# EAGLE schematic Resistor_Resistor (EAGLE 8.3.0), part 7 of 43 (continued)
## Parts (continued)
R9514  10K  RESISTOR_0201  [0201]
R9515  10K  RESISTOR_0201  [0201]
R9516  10K  RESISTOR_0201  [0201]
R9517  10K  RESISTOR_0201  [0201]
R9518  10K  RESISTOR_0201  [0201]
R9519  10K  RESISTOR_0201  [0201]
R9520  10K  RESISTOR_0201  [0201]
R9521  10K  RESISTOR_0201  [0201]
R9522  10K  RESISTOR_0201  [0201]
R9523  10K  RESISTOR_0201  [0201]
R9524  10K  RESISTOR_0201  [0201]
R9525  10K  RESISTOR_0201  [0201]
R9526  10K  RESISTOR_0201  [0201]
R9527  10K  RESISTOR_0201  [0201]
R9528  10K  RESISTOR_0201  [0201]
R9529  10K  RESISTOR_0201  [0201]
R9530  10K  RESISTOR_0201  [0201]
R9531  10K  RESISTOR_0201  [0201]
R9532  10K  RESISTOR_0201  [0201]
R9533  10K  RESISTOR_0201  [0201]
R9534  10K  RESISTOR_0201  [0201]
R9535  10K  RESISTOR_0201  [0201]
R9536  10K  RESISTOR_0201  [0201]
R9537  10K  RESISTOR_0201  [0201]
R9538  10K  RESISTOR_0201  [0201]
R9539  10K  RESISTOR_0201  [0201]
R9540  10K  RESISTOR_0201  [0201]
R9541  10K  RESISTOR_0201  [0201]
R9542  10K  RESISTOR_0201  [0201]
R9543  10K  RESISTOR_0201  [0201]
R9544  10K  RESISTOR_0201  [0201]
R9545  10K  RESISTOR_0201  [0201]
R9546  10K  RESISTOR_0201  [0201]
R9547  10K  RESISTOR_0201  [0201]
R9548  10K  RESISTOR_0201  [0201]
R9549  10K  RESISTOR_0201  [0201]
R9550  10K  RESISTOR_0201  [0201]
R9551  10K  RESISTOR_0201  [0201]
R9552  10K  RESISTOR_0201  [0201]
R9553  10K  RESISTOR_0201  [0201]
R9554  10K  RESISTOR_0201  [0201]
R9555  10K  RESISTOR_0201  [0201]
R9556  10K  RESISTOR_0201  [0201]
R9557  10K  RESISTOR_0201  [0201]
R9558  10K  RESISTOR_0201  [0201]
R9559  10K  RESISTOR_0201  [0201]
R9560  10K  RESISTOR_0201  [0201]
R9561  10K  RESISTOR_0201  [0201]
R9562  10K  RESISTOR_0201  [0201]
R9563  10K  RESISTOR_0201  [0201]
R9564  10K  RESISTOR_0201  [0201]
R9565  10K  RESISTOR_0201  [0201]
R9566  10K  RESISTOR_0201  [0201]
R9567  10K  RESISTOR_0201  [0201]
R9568  10K  RESISTOR_0201  [0201]
R9569  10K  RESISTOR_0201  [0201]
R9570  10K  RESISTOR_0201  [0201]
R9571  10K  RESISTOR_0201  [0201]
R9572  10K  RESISTOR_0201  [0201]
R9573  10K  RESISTOR_0201  [0201]
R9574  10K  RESISTOR_0201  [0201]
R9575  10K  RESISTOR_0201  [0201]
R9576  10K  RESISTOR_0201  [0201]
R9577  10K  RESISTOR_0201  [0201]
R9578  10K  RESISTOR_0201  [0201]
R9579  10K  RESISTOR_0201  [0201]
R9580  10K  RESISTOR_0201  [0201]
R9581  10K  RESISTOR_0201  [0201]
R9582  10K  RESISTOR_0201  [0201]
R9583  10K  RESISTOR_0201  [0201]
R9584  10K  RESISTOR_0201  [0201]
R9585  10K  RESISTOR_0201  [0201]
R9586  10K  RESISTOR_0201  [0201]
R9587  10K  RESISTOR_0201  [0201]
R9588  10K  RESISTOR_0201  [0201]
R9589  10K  RESISTOR_0201  [0201]
R9590  10K  RESISTOR_0201  [0201]
R9591  10K  RESISTOR_0201  [0201]
R9592  10K  RESISTOR_0201  [0201]
R9593  10K  RESISTOR_0201  [0201]
R9594  10K  RESISTOR_0201  [0201]
R9595  10K  RESISTOR_0201  [0201]
R9596  10K  RESISTOR_0201  [0201]
R9597  10K  RESISTOR_0201  [0201]
R9598  10K  RESISTOR_0201  [0201]
R9599  10K  RESISTOR_0201  [0201]
R9600  10K  RESISTOR_0201  [0201]
R9601  10K  RESISTOR_0201  [0201]
R9602  10K  RESISTOR_0201  [0201]
R9603  10K  RESISTOR_0201  [0201]
R9604  10K  RESISTOR_0201  [0201]
R9605  10K  RESISTOR_0201  [0201]
R9606  10K  RESISTOR_0201  [0201]
R9607  10K  RESISTOR_0201  [0201]
R9608  10K  RESISTOR_0201  [0201]
R9609  10K  RESISTOR_0201  [0201]
R9610  10K  RESISTOR_0201  [0201]
R9611  10K  RESISTOR_0201  [0201]
R9612  10K  RESISTOR_0201  [0201]
R9613  10K  RESISTOR_0201  [0201]
R9614  10K  RESISTOR_0201  [0201]
R9615  10K  RESISTOR_0201  [0201]
R9616  10K  RESISTOR_0201  [0201]
R9617  10K  RESISTOR_0201  [0201]
R9618  10K  RESISTOR_0201  [0201]
R9619  10K  RESISTOR_0201  [0201]
R9620  10K  RESISTOR_0201  [0201]
R9621  10K  RESISTOR_0201  [0201]
R9622  10K  RESISTOR_0201  [0201]
R9623  10K  RESISTOR_0201  [0201]
R9624  10K  RESISTOR_0201  [0201]
R9625  10K  RESISTOR_0201  [0201]
R9626  10K  RESISTOR_0201  [0201]
R9627  10K  RESISTOR_0201  [0201]
R9628  10K  RESISTOR_0201  [0201]
R9629  10K  RESISTOR_0201  [0201]
R9630  10K  RESISTOR_0201  [0201]
R9631  10K  RESISTOR_0201  [0201]
R9632  10K  RESISTOR_0201  [0201]
R9633  10K  RESISTOR_0201  [0201]
R9634  10K  RESISTOR_0201  [0201]
R9635  10K  RESISTOR_0201  [0201]
R9636  10K  RESISTOR_0201  [0201]
R9637  10K  RESISTOR_0201  [0201]
R9638  10K  RESISTOR_0201  [0201]
R9639  10K  RESISTOR_0201  [0201]
R9640  10K  RESISTOR_0201  [0201]
R9641  10K  RESISTOR_0201  [0201]
R9642  10K  RESISTOR_0201  [0201]
R9643  10K  RESISTOR_0201  [0201]
R9644  10K  RESISTOR_0201  [0201]
R9645  10K  RESISTOR_0201  [0201]
R9646  10K  RESISTOR_0201  [0201]
R9647  10K  RESISTOR_0201  [0201]
R9648  10K  RESISTOR_0201  [0201]
R9649  10K  RESISTOR_0201  [0201]
R9650  10K  RESISTOR_0201  [0201]
R9651  10K  RESISTOR_0201  [0201]
R9652  10K  RESISTOR_0201  [0201]
R9653  10K  RESISTOR_0201  [0201]
R9654  10K  RESISTOR_0201  [0201]
R9655  10K  RESISTOR_0201  [0201]
R9656  10K  RESISTOR_0201  [0201]
R9657  10K  RESISTOR_0201  [0201]
R9658  10K  RESISTOR_0201  [0201]
R9659  10K  RESISTOR_0201  [0201]
R9660  10K  RESISTOR_0201  [0201]
R9661  10K  RESISTOR_0201  [0201]
R9662  10K  RESISTOR_0201  [0201]
R9663  10K  RESISTOR_0201  [0201]
R9664  10K  RESISTOR_0201  [0201]
R9665  10K  RESISTOR_0201  [0201]
R9666  10K  RESISTOR_0201  [0201]
R9667  10K  RESISTOR_0201  [0201]
R9668  10K  RESISTOR_0201  [0201]
R9669  10K  RESISTOR_0201  [0201]
R9670  10K  RESISTOR_0201  [0201]
R9671  10K  RESISTOR_0201  [0201]
R9672  10K  RESISTOR_0201  [0201]
R9673  10K  RESISTOR_0201  [0201]
R9674  10K  RESISTOR_0201  [0201]
R9675  10K  RESISTOR_0201  [0201]
R9676  10K  RESISTOR_0201  [0201]
R9677  10K  RESISTOR_0201  [0201]
R9678  10K  RESISTOR_0201  [0201]
R9679  10K  RESISTOR_0201  [0201]
R9680  10K  RESISTOR_0201  [0201]
R9681  10K  RESISTOR_0201  [0201]
R9682  10K  RESISTOR_0201  [0201]
R9683  10K  RESISTOR_0201  [0201]
R9684  10K  RESISTOR_0201  [0201]
R9685  10K  RESISTOR_0201  [0201]
R9686  10K  RESISTOR_0201  [0201]
R9687  10K  RESISTOR_0201  [0201]
R9688  10K  RESISTOR_0201  [0201]
R9689  10K  RESISTOR_0201  [0201]
R9690  10K  RESISTOR_0201  [0201]
R9691  10K  RESISTOR_0201  [0201]
R9692  10K  RESISTOR_0201  [0201]
R9693  10K  RESISTOR_0201  [0201]
R9694  10K  RESISTOR_0201  [0201]
R9695  10K  RESISTOR_0201  [0201]
R9696  10K  RESISTOR_0201  [0201]
R9697  10K  RESISTOR_0201  [0201]
R9698  10K  RESISTOR_0201  [0201]
R9699  10K  RESISTOR_0201  [0201]
R9700  10K  RESISTOR_0201  [0201]
R9701  10K  RESISTOR_0201  [0201]
R9702  10K  RESISTOR_0201  [0201]
R9703  10K  RESISTOR_0201  [0201]
R9704  10K  RESISTOR_0201  [0201]
R9705  10K  RESISTOR_0201  [0201]
R9706  10K  RESISTOR_0201  [0201]
R9707  10K  RESISTOR_0201  [0201]
R9708  10K  RESISTOR_0201  [0201]
R9709  10K  RESISTOR_0201  [0201]
R9710  10K  RESISTOR_0201  [0201]
R9711  10K  RESISTOR_0201  [0201]
R9712  10K  RESISTOR_0201  [0201]
R9713  10K  RESISTOR_0201  [0201]
R9714  10K  RESISTOR_0201  [0201]
R9715  10K  RESISTOR_0201  [0201]
R9716  10K  RESISTOR_0201  [0201]
R9717  10K  RESISTOR_0201  [0201]
R9718  10K  RESISTOR_0201  [0201]
R9719  10K  RESISTOR_0201  [0201]
R9720  10K  RESISTOR_0201  [0201]
R9721  10K  RESISTOR_0201  [0201]
R9722  10K  RESISTOR_0201  [0201]
R9723  10K  RESISTOR_0201  [0201]
R9724  10K  RESISTOR_0201  [0201]
R9725  10K  RESISTOR_0201  [0201]
R9726  10K  RESISTOR_0201  [0201]
R9727  10K  RESISTOR_0201  [0201]
R9728  10K  RESISTOR_0201  [0201]
R9729  10K  RESISTOR_0201  [0201]
R9730  10K  RESISTOR_0201  [0201]
R9731  10K  RESISTOR_0201  [0201]
R9732  10K  RESISTOR_0201  [0201]
R9733  10K  RESISTOR_0201  [0201]
R9734  10K  RESISTOR_0201  [0201]
R9735  10K  RESISTOR_0201  [0201]
R9736  10K  RESISTOR_0201  [0201]
R9737  10K  RESISTOR_0201  [0201]
R9738  10K  RESISTOR_0201  [0201]
R9739  10K  RESISTOR_0201  [0201]
R9740  10K  RESISTOR_0201  [0201]
R9741  10K  RESISTOR_0201  [0201]
R9742  10K  RESISTOR_0201  [0201]
R9743  10K  RESISTOR_0201  [0201]
R9744  10K  RESISTOR_0201  [0201]
R9745  10K  RESISTOR_0201  [0201]
R9746  10K  RESISTOR_0201  [0201]
R9747  10K  RESISTOR_0201  [0201]
R9748  10K  RESISTOR_0201  [0201]
R9749  10K  RESISTOR_0201  [0201]
R9750  10K  RESISTOR_0201  [0201]
R9751  10K  RESISTOR_0201  [0201]
R9752  10K  RESISTOR_0201  [0201]
R9753  10K  RESISTOR_0201  [0201]
R9754  10K  RESISTOR_0201  [0201]
R9755  10K  RESISTOR_0201  [0201]
R9756  10K  RESISTOR_0201  [0201]
R9757  10K  RESISTOR_0201  [0201]
R9758  10K  RESISTOR_0201  [0201]
R9759  10K  RESISTOR_0201  [0201]
R9760  10K  RESISTOR_0201  [0201]
R9761  10K  RESISTOR_0201  [0201]
R9762  10K  RESISTOR_0201  [0201]
R9763  10K  RESISTOR_0201  [0201]
R9764  10K  RESISTOR_0201  [0201]
R9765  10K  RESISTOR_0201  [0201]
R9766  10K  RESISTOR_0201  [0201]
R9767  10K  RESISTOR_0201  [0201]
R9768  10K  RESISTOR_0201  [0201]
R9769  10K  RESISTOR_0201  [0201]
R9770  10K  RESISTOR_0201  [0201]
R9771  10K  RESISTOR_0201  [0201]
R9772  10K  RESISTOR_0201  [0201]
R9773  10K  RESISTOR_0201  [0201]
R9774  10K  RESISTOR_0201  [0201]
R9775  10K  RESISTOR_0201  [0201]
R9776  10K  RESISTOR_0201  [0201]
R9777  10K  RESISTOR_0201  [0201]
R9778  10K  RESISTOR_0201  [0201]
R9779  10K  RESISTOR_0201  [0201]
R9780  10K  RESISTOR_0201  [0201]
R9781  10K  RESISTOR_0201  [0201]
R9782  10K  RESISTOR_0201  [0201]
R9783  10K  RESISTOR_0201  [0201]
R9784  10K  RESISTOR_0201  [0201]
R9785  10K  RESISTOR_0201  [0201]
R9786  10K  RESISTOR_0201  [0201]
R9787  10K  RESISTOR_0201  [0201]
R9788  10K  RESISTOR_0201  [0201]
R9789  10K  RESISTOR_0201  [0201]
R9790  10K  RESISTOR_0201  [0201]
R9791  10K  RESISTOR_0201  [0201]
R9792  10K  RESISTOR_0201  [0201]
R9793  10K  RESISTOR_0201  [0201]
R9794  10K  RESISTOR_0201  [0201]
R9795  10K  RESISTOR_0201  [0201]
R9796  10K  RESISTOR_0201  [0201]
R9797  10K  RESISTOR_0201  [0201]
R9798  10K  RESISTOR_0201  [0201]
R9799  10K  RESISTOR_0201  [0201]
R9800  10K  RESISTOR_0201  [0201]
R9801  10K  RESISTOR_0201  [0201]
R9802  10K  RESISTOR_0201  [0201]
R9803  10K  RESISTOR_0201  [0201]
R9804  10K  RESISTOR_0201  [0201]
R9805  10K  RESISTOR_0201  [0201]
R9806  10K  RESISTOR_0201  [0201]
R9807  10K  RESISTOR_0201  [0201]
R9808  10K  RESISTOR_0201  [0201]
R9809  10K  RESISTOR_0201  [0201]
R9810  10K  RESISTOR_0201  [0201]
R9811  10K  RESISTOR_0201  [0201]
R9812  10K  RESISTOR_0201  [0201]
R9813  10K  RESISTOR_0201  [0201]
R9814  10K  RESISTOR_0201  [0201]
R9815  10K  RESISTOR_0201  [0201]
R9816  10K  RESISTOR_0201  [0201]
R9817  10K  RESISTOR_0201  [0201]
R9818  10K  RESISTOR_0201  [0201]
R9819  10K  RESISTOR_0201  [0201]
R9820  10K  RESISTOR_0201  [0201]
R9821  10K  RESISTOR_0201  [0201]
R9822  10K  RESISTOR_0201  [0201]
R9823  10K  RESISTOR_0201  [0201]
R9824  10K  RESISTOR_0201  [0201]
R9825  10K  RESISTOR_0201  [0201]
R9826  10K  RESISTOR_0201  [0201]
R9827  10K  RESISTOR_0201  [0201]
R9828  10K  RESISTOR_0201  [0201]
R9829  10K  RESISTOR_0201  [0201]
R9830  10K  RESISTOR_0201  [0201]
R9831  10K  RESISTOR_0201  [0201]
R9832  10K  RESISTOR_0201  [0201]
R9833  10K  RESISTOR_0201  [0201]
R9834  10K  RESISTOR_0201  [0201]
R9835  10K  RESISTOR_0201  [0201]
R9836  10K  RESISTOR_0201  [0201]
R9837  10K  RESISTOR_0201  [0201]
R9838  10K  RESISTOR_0201  [0201]
R9839  10K  RESISTOR_0201  [0201]
R9840  10K  RESISTOR_0201  [0201]
R9841  10K  RESISTOR_0201  [0201]
R9842  10K  RESISTOR_0201  [0201]
R9843  10K  RESISTOR_0201  [0201]
R9844  10K  RESISTOR_0201  [0201]
R9845  10K  RESISTOR_0201  [0201]
R9846  10K  RESISTOR_0201  [0201]
R9847  10K  RESISTOR_0201  [0201]
R9848  10K  RESISTOR_0201  [0201]
R9849  10K  RESISTOR_0201  [0201]
R9850  10K  RESISTOR_0201  [0201]
R9851  10K  RESISTOR_0201  [0201]
R9852  10K  RESISTOR_0201  [0201]
R9853  10K  RESISTOR_0201  [0201]
R9854  10K  RESISTOR_0201  [0201]
R9855  10K  RESISTOR_0201  [0201]
R9856  10K  RESISTOR_0201  [0201]
R9857  10K  RESISTOR_0201  [0201]
R9858  10K  RESISTOR_0201  [0201]
R9859  10K  RESISTOR_0201  [0201]
R9860  10K  RESISTOR_0201  [0201]
R9861  10K  RESISTOR_0201  [0201]
R9862  10K  RESISTOR_0201  [0201]
R9863  10K  RESISTOR_0201  [0201]
R9864  10K  RESISTOR_0201  [0201]
R9865  10K  RESISTOR_0201  [0201]
R9866  10K  RESISTOR_0201  [0201]
R9867  10K  RESISTOR_0201  [0201]
R9868  10K  RESISTOR_0201  [0201]
R9869  10K  RESISTOR_0201  [0201]
R9870  10K  RESISTOR_0201  [0201]
R9871  10K  RESISTOR_0201  [0201]
R9872  10K  RESISTOR_0201  [0201]
R9873  10K  RESISTOR_0201  [0201]
R9874  10K  RESISTOR_0201  [0201]
R9875  10K  RESISTOR_0201  [0201]
R9876  10K  RESISTOR_0201  [0201]
R9877  10K  RESISTOR_0201  [0201]
R9878  10K  RESISTOR_0201  [0201]
R9879  10K  RESISTOR_0201  [0201]
R9880  10K  RESISTOR_0201  [0201]
R9881  10K  RESISTOR_0201  [0201]
R9882  10K  RESISTOR_0201  [0201]
R9883  10K  RESISTOR_0201  [0201]
R9884  10K  RESISTOR_0201  [0201]
R9885  10K  RESISTOR_0201  [0201]
R9886  10K  RESISTOR_0201  [0201]
R9887  10K  RESISTOR_0201  [0201]
R9888  10K  RESISTOR_0201  [0201]
R9889  10K  RESISTOR_0201  [0201]
R9890  10K  RESISTOR_0201  [0201]
R9891  10K  RESISTOR_0201  [0201]
R9892  10K  RESISTOR_0201  [0201]
R9893  10K  RESISTOR_0201  [0201]
R9894  10K  RESISTOR_0201  [0201]
R9895  10K  RESISTOR_0201  [0201]
R9896  10K  RESISTOR_0201  [0201]
R9897  10K  RESISTOR_0201  [0201]
R9898  10K  RESISTOR_0201  [0201]
R9899  10K  RESISTOR_0201  [0201]
R9900  10K  RESISTOR_0201  [0201]
R9901  10K  RESISTOR_0201  [0201]
R9902  10K  RESISTOR_0201  [0201]
R9903  10K  RESISTOR_0201  [0201]
R9904  10K  RESISTOR_0201  [0201]
R9905  10K  RESISTOR_0201  [0201]
R9906  10K  RESISTOR_0201  [0201]
R9907  10K  RESISTOR_0201  [0201]
R9908  10K  RESISTOR_0201  [0201]
R9909  10K  RESISTOR_0201  [0201]
R9910  10K  RESISTOR_0201  [0201]
R9911  10K  RESISTOR_0201  [0201]
R9912  10K  RESISTOR_0201  [0201]
R9913  10K  RESISTOR_0201  [0201]
R9914  10K  RESISTOR_0201  [0201]
R9915  10K  RESISTOR_0201  [0201]
R9916  10K  RESISTOR_0201  [0201]
R9917  10K  RESISTOR_0201  [0201]
R9918  10K  RESISTOR_0201  [0201]
R9919  10K  RESISTOR_0201  [0201]
R9920  10K  RESISTOR_0201  [0201]
R9921  10K  RESISTOR_0201  [0201]
R9922  10K  RESISTOR_0201  [0201]
R9923  10K  RESISTOR_0201  [0201]
R9924  10K  RESISTOR_0201  [0201]
R9925  10K  RESISTOR_0201  [0201]
R9926  10K  RESISTOR_0201  [0201]
R9927  10K  RESISTOR_0201  [0201]
R9928  10K  RESISTOR_0201  [0201]
R9929  10K  RESISTOR_0201  [0201]
R9930  10K  RESISTOR_0201  [0201]
R9931  10K  RESISTOR_0201  [0201]
R9932  10K  RESISTOR_0201  [0201]
R9933  10K  RESISTOR_0201  [0201]
R9934  10K  RESISTOR_0201  [0201]
R9935  10K  RESISTOR_0201  [0201]
R9936  10K  RESISTOR_0201  [0201]
R9937  10K  RESISTOR_0201  [0201]
R9938  10K  RESISTOR_0201  [0201]
R9939  10K  RESISTOR_0201  [0201]
R9940  10K  RESISTOR_0201  [0201]
R9941  10K  RESISTOR_0201  [0201]
R9942  10K  RESISTOR_0201  [0201]
R9943  10K  RESISTOR_0201  [0201]
R9944  10K  RESISTOR_0201  [0201]
R9945  10K  RESISTOR_0201  [0201]
R9946  10K  RESISTOR_0201  [0201]
R9947  10K  RESISTOR_0201  [0201]
R9948  10K  RESISTOR_0201  [0201]
R9949  10K  RESISTOR_0201  [0201]
R9950  10K  RESISTOR_0201  [0201]
R9951  10K  RESISTOR_0201  [0201]
R9952  10K  RESISTOR_0201  [0201]
R9953  10K  RESISTOR_0201  [0201]
R9954  10K  RESISTOR_0201  [0201]
R9955  10K  RESISTOR_0201  [0201]
R9956  10K  RESISTOR_0201  [0201]
R9957  10K  RESISTOR_0201  [0201]
R9958  10K  RESISTOR_0201  [0201]
R9959  10K  RESISTOR_0201  [0201]
R9960  10K  RESISTOR_0201  [0201]
R9961  10K  RESISTOR_0201  [0201]
R9962  10K  RESISTOR_0201  [0201]
R9963  10K  RESISTOR_0201  [0201]
R9964  10K  RESISTOR_0201  [0201]
R9965  10K  RESISTOR_0201  [0201]
R9966  10K  RESISTOR_0201  [0201]
R9967  10K  RESISTOR_0201  [0201]
R9968  10K  RESISTOR_0201  [0201]
R9969  10K  RESISTOR_0201  [0201]
R9970  10K  RESISTOR_0201  [0201]
R9971  10K  RESISTOR_0201  [0201]
R9972  10K  RESISTOR_0201  [0201]
R9973  10K  RESISTOR_0201  [0201]
R9974  10K  RESISTOR_0201  [0201]
R9975  10K  RESISTOR_0201  [0201]
R9976  10K  RESISTOR_0201  [0201]
R9977  10K  RESISTOR_0201  [0201]
R9978  10K  RESISTOR_0201  [0201]
R9979  10K  RESISTOR_0201  [0201]
R9980  10K  RESISTOR_0201  [0201]
R9981  10K  RESISTOR_0201  [0201]
R9982  10K  RESISTOR_0201  [0201]
R9983  10K  RESISTOR_0201  [0201]
R9984  10K  RESISTOR_0201  [0201]
R9985  10K  RESISTOR_0201  [0201]
R9986  10K  RESISTOR_0201  [0201]
R9987  10K  RESISTOR_0201  [0201]
R9988  10K  RESISTOR_0201  [0201]
R9989  10K  RESISTOR_0201  [0201]
R9990  10K  RESISTOR_0201  [0201]
R9991  10K  RESISTOR_0201  [0201]
R9992  10K  RESISTOR_0201  [0201]
R9993  10K  RESISTOR_0201  [0201]
R9994  10K  RESISTOR_0201  [0201]
R9995  10K  RESISTOR_0201  [0201]
R9996  10K  RESISTOR_0201  [0201]
R9997  10K  RESISTOR_0201  [0201]
R9998  10K  RESISTOR_0201  [0201]
R9999  10K  RESISTOR_0201  [0201]
R10000  10K  RESISTOR_0201  [0201]
R10001  10K  RESISTOR_0201  [0201]
R10002  10K  RESISTOR_0201  [0201]
R10003  10K  RESISTOR_0201  [0201]
R10004  10K  RESISTOR_0201  [0201]
R10005  10K  RESISTOR_0201  [0201]
R10006  10K  RESISTOR_0201  [0201]
R10007  10K  RESISTOR_0201  [0201]
R10008  10K  RESISTOR_0201  [0201]
R10009  10K  RESISTOR_0201  [0201]
R10010  10K  RESISTOR_0201  [0201]
R10011  10K  RESISTOR_0201  [0201]
R10012  10K  RESISTOR_0201  [0201]
R10013  10K  RESISTOR_0201  [0201]
R10014  10K  RESISTOR_0201  [0201]
R10015  10K  RESISTOR_0201  [0201]
R10016  10K  RESISTOR_0201  [0201]
R10017  10K  RESISTOR_0201  [0201]
R10018  10K  RESISTOR_0201  [0201]
R10019  10K  RESISTOR_0201  [0201]
R10020  10K  RESISTOR_0201  [0201]
R10021  10K  RESISTOR_0201  [0201]
R10022  10K  RESISTOR_0201  [0201]
R10023  10K  RESISTOR_0201  [0201]
R10024  10K  RESISTOR_0201  [0201]
R10025  10K  RESISTOR_0201  [0201]
R10026  10K  RESISTOR_0201  [0201]
R10027  10K  RESISTOR_0201  [0201]
R10028  10K  RESISTOR_0201  [0201]
R10029  10K  RESISTOR_0201  [0201]
R10030  10K  RESISTOR_0201  [0201]
R10031  10K  RESISTOR_0201  [0201]
R10032  10K  RESISTOR_0201  [0201]
R10033  10K  RESISTOR_0201  [0201]
R10034  10K  RESISTOR_0201  [0201]
R10035  10K  RESISTOR_0201  [0201]
R10036  10K  RESISTOR_0201  [0201]
R10037  10K  RESISTOR_0201  [0201]
R10038  10K  RESISTOR_0201  [0201]
R10039  10K  RESISTOR_0201  [0201]
R10040  10K  RESISTOR_0201  [0201]
R10041  10K  RESISTOR_0201  [0201]
R10042  10K  RESISTOR_0201  [0201]
R10043  10K  RESISTOR_0201  [0201]
R10044  10K  RESISTOR_0201  [0201]
R10045  10K  RESISTOR_0201  [0201]
R10046  10K  RESISTOR_0201  [0201]
R10047  10K  RESISTOR_0201  [0201]
R10048  10K  RESISTOR_0201  [0201]
R10049  10K  RESISTOR_0201  [0201]
R10050  10K  RESISTOR_0201  [0201]
R10051  10K  RESISTOR_0201  [0201]
R10052  10K  RESISTOR_0201  [0201]
R10053  10K  RESISTOR_0201  [0201]
R10054  10K  RESISTOR_0201  [0201]
R10055  10K  RESISTOR_0201  [0201]
R10056  10K  RESISTOR_0201  [0201]
R10057  10K  RESISTOR_0201  [0201]
R10058  10K  RESISTOR_0201  [0201]
R10059  10K  RESISTOR_0201  [0201]
R10060  10K  RESISTOR_0201  [0201]
R10061  10K  RESISTOR_0201  [0201]
R10062  10K  RESISTOR_0201  [0201]
R10063  10K  RESISTOR_0201  [0201]
R10064  10K  RESISTOR_0201  [0201]
R10065  10K  RESISTOR_0201  [0201]
R10066  10K  RESISTOR_0201  [0201]
R10067  10K  RESISTOR_0201  [0201]
R10068  10K  RESISTOR_0201  [0201]
R10069  10K  RESISTOR_0201  [0201]
R10070  10K  RESISTOR_0201  [0201]
R10071  10K  RESISTOR_0201  [0201]
R10072  10K  RESISTOR_0201  [0201]
R10073  10K  RESISTOR_0201  [0201]
R10074  10K  RESISTOR_0201  [0201]
R10075  10K  RESISTOR_0201  [0201]
R10076  10K  RESISTOR_0201  [0201]
R10077  10K  RESISTOR_0201  [0201]
R10078  10K  RESISTOR_0201  [0201]
R10079  10K  RESISTOR_0201  [0201]
R10080  10K  RESISTOR_0201  [0201]
R10081  10K  RESISTOR_0201  [0201]
R10082  10K  RESISTOR_0201  [0201]
R10083  10K  RESISTOR_0201  [0201]
R10084  10K  RESISTOR_0201  [0201]
R10085  10K  RESISTOR_0201  [0201]
R10086  10K  RESISTOR_0201  [0201]
R10087  10K  RESISTOR_0201  [0201]
R10088  10K  RESISTOR_0201  [0201]
R10089  10K  RESISTOR_0201  [0201]
R10090  10K  RESISTOR_0201  [0201]
R10091  10K  RESISTOR_0201  [0201]
R10092  10K  RESISTOR_0201  [0201]
R10093  10K  RESISTOR_0201  [0201]
R10094  10K  RESISTOR_0201  [0201]
R10095  10K  RESISTOR_0201  [0201]
R10096  10K  RESISTOR_0201  [0201]
R10097  10K  RESISTOR_0201  [0201]
R10098  10K  RESISTOR_0201  [0201]
R10099  10K  RESISTOR_0201  [0201]
R10100  10K  RESISTOR_0201  [0201]
R10101  10K  RESISTOR_0201  [0201]
R10102  10K  RESISTOR_0201  [0201]
R10103  10K  RESISTOR_0201  [0201]
R10104  10K  RESISTOR_0201  [0201]
R10105  10K  RESISTOR_0201  [0201]
R10106  10K  RESISTOR_0201  [0201]
R10107  10K  RESISTOR_0201  [0201]
R10108  10K  RESISTOR_0201  [0201]
R10109  10K  RESISTOR_0201  [0201]
R10110  10K  RESISTOR_0201  [0201]
R10111  10K  RESISTOR_0201  [0201]
R10112  10K  RESISTOR_0201  [0201]
R10113  10K  RESISTOR_0201  [0201]
R10114  10K  RESISTOR_0201  [0201]
R10115  10K  RESISTOR_0201  [0201]
R10116  10K  RESISTOR_0201  [0201]
R10117  10K  RESISTOR_0201  [0201]
R10118  10K  RESISTOR_0201  [0201]
R10119  10K  RESISTOR_0201  [0201]
R10120  10K  RESISTOR_0201  [0201]
R10121  10K  RESISTOR_0201  [0201]
R10122  10K  RESISTOR_0201  [0201]
R10123  10K  RESISTOR_0201  [0201]
R10124  10K  RESISTOR_0201  [0201]
R10125  10K  RESISTOR_0201  [0201]
R10126  10K  RESISTOR_0201  [0201]
R10127  10K  RESISTOR_0201  [0201]
R10128  10K  RESISTOR_0201  [0201]
R10129  10K  RESISTOR_0201  [0201]
R10130  10K  RESISTOR_0201  [0201]
R10131  10K  RESISTOR_0201  [0201]
R10132  10K  RESISTOR_0201  [0201]
R10133  10K  RESISTOR_0201  [0201]
R10134  10K  RESISTOR_0201  [0201]
R10135  10K  RESISTOR_0201  [0201]
R10136  10K  RESISTOR_0201  [0201]
R10137  10K  RESISTOR_0201  [0201]
R10138  10K  RESISTOR_0201  [0201]
R10139  10K  RESISTOR_0201  [0201]
R10140  10K  RESISTOR_0201  [0201]
R10141  10K  RESISTOR_0201  [0201]
R10142  10K  RESISTOR_0201  [0201]
R10143  10K  RESISTOR_0201  [0201]
R10144  10K  RESISTOR_0201  [0201]
R10145  10K  RESISTOR_0201  [0201]
R10146  10K  RESISTOR_0201  [0201]
R10147  10K  RESISTOR_0201  [0201]
R10148  10K  RESISTOR_0201  [0201]
R10149  10K  RESISTOR_0201  [0201]
R10150  10K  RESISTOR_0201  [0201]
R10151  10K  RESISTOR_0201  [0201]
R10152  10K  RESISTOR_0201  [0201]
R10153  10K  RESISTOR_0201  [0201]
R10154  10K  RESISTOR_0201  [0201]
R10155  10K  RESISTOR_0201  [0201]
R10156  10K  RESISTOR_0201  [0201]
R10157  10K  RESISTOR_0201  [0201]
R10158  10K  RESISTOR_0201  [0201]
R10159  10K  RESISTOR_0201  [0201]
R10160  10K  RESISTOR_0201  [0201]
R10161  10K  RESISTOR_0201  [0201]
R10162  10K  RESISTOR_0201  [0201]
R10163  10K  RESISTOR_0201  [0201]
R10164  10K  RESISTOR_0201  [0201]
R10165  10K  RESISTOR_0201  [0201]
R10166  10K  RESISTOR_0201  [0201]
R10167  10K  RESISTOR_0201  [0201]
R10168  10K  RESISTOR_0201  [0201]
R10169  10K  RESISTOR_0201  [0201]
R10170  10K  RESISTOR_0201  [0201]
R10171  10K  RESISTOR_0201  [0201]
R10172  10K  RESISTOR_0201  [0201]
R10173  10K  RESISTOR_0201  [0201]
R10174  10K  RESISTOR_0201  [0201]
R10175  10K  RESISTOR_0201  [0201]
R10176  10K  RESISTOR_0201  [0201]
R10177  10K  RESISTOR_0201  [0201]
R10178  10K  RESISTOR_0201  [0201]
R10179  10K  RESISTOR_0201  [0201]
R10180  10K  RESISTOR_0201  [0201]
R10181  10K  RESISTOR_0201  [0201]
R10182  10K  RESISTOR_0201  [0201]
R10183  10K  RESISTOR_0201  [0201]
R10184  10K  RESISTOR_0201  [0201]
R10185  10K  RESISTOR_0201  [0201]
R10186  10K  RESISTOR_0201  [0201]
R10187  10K  RESISTOR_0201  [0201]
R10188  10K  RESISTOR_0201  [0201]
R10189  10K  RESISTOR_0201  [0201]
R10190  10K  RESISTOR_0201  [0201]
R10191  10K  RESISTOR_0201  [0201]
R10192  10K  RESISTOR_0201  [0201]
R10193  10K  RESISTOR_0201  [0201]
R10194  10K  RESISTOR_0201  [0201]
R10195  10K  RESISTOR_0201  [0201]
R10196  10K  RESISTOR_0201  [0201]
R10197  10K  RESISTOR_0201  [0201]
R10198  10K  RESISTOR_0201  [0201]
R10199  10K  RESISTOR_0201  [0201]
R10200  10K  RESISTOR_0201  [0201]
R10201  10K  RESISTOR_0201  [0201]
R10202  10K  RESISTOR_0201  [0201]
R10203  10K  RESISTOR_0201  [0201]
R10204  10K  RESISTOR_0201  [0201]
R10205  10K  RESISTOR_0201  [0201]
R10206  10K  RESISTOR_0201  [0201]
R10207  10K  RESISTOR_0201  [0201]
R10208  10K  RESISTOR_0201  [0201]
R10209  10K  RESISTOR_0201  [0201]
R10210  10K  RESISTOR_0201  [0201]
R10211  10K  RESISTOR_0201  [0201]
R10212  10K  RESISTOR_0201  [0201]
R10213  10K  RESISTOR_0201  [0201]
R10214  10K  RESISTOR_0201  [0201]
R10215  10K  RESISTOR_0201  [0201]
R10216  10K  RESISTOR_0201  [0201]
R10217  10K  RESISTOR_0201  [0201]
R10218  10K  RESISTOR_0201  [0201]
R10219  10K  RESISTOR_0201  [0201]
R10220  10K  RESISTOR_0201  [0201]
R10221  10K  RESISTOR_0201  [0201]
R10222  10K  RESISTOR_0201  [0201]
R10223  10K  RESISTOR_0201  [0201]
R10224  10K  RESISTOR_0201  [0201]
R10225  10K  RESISTOR_0201  [0201]
R10226  10K  RESISTOR_0201  [0201]
R10227  10K  RESISTOR_0201  [0201]
R10228  10K  RESISTOR_0201  [0201]
R10229  10K  RESISTOR_0201  [0201]
R10230  10K  RESISTOR_0201  [0201]
R10231  10K  RESISTOR_0201  [0201]
R10232  10K  RESISTOR_0201  [0201]
R10233  10K  RESISTOR_0201  [0201]
R10234  10K  RESISTOR_0201  [0201]
R10235  10K  RESISTOR_0201  [0201]
R10236  10K  RESISTOR_0201  [0201]
R10237  10K  RESISTOR_0201  [0201]